# EasyEDA Pro project Jarvis.eprj, schematic Schematic2
Board Name: Memory; Create Date: 2026-04-10; Page Name: P1; Project Name: Jarvis; Schematic Name: Schematic2; Update Date: 2026-04-12; Company: EasyEDA.com; Page Size: A4; Version: V1.0
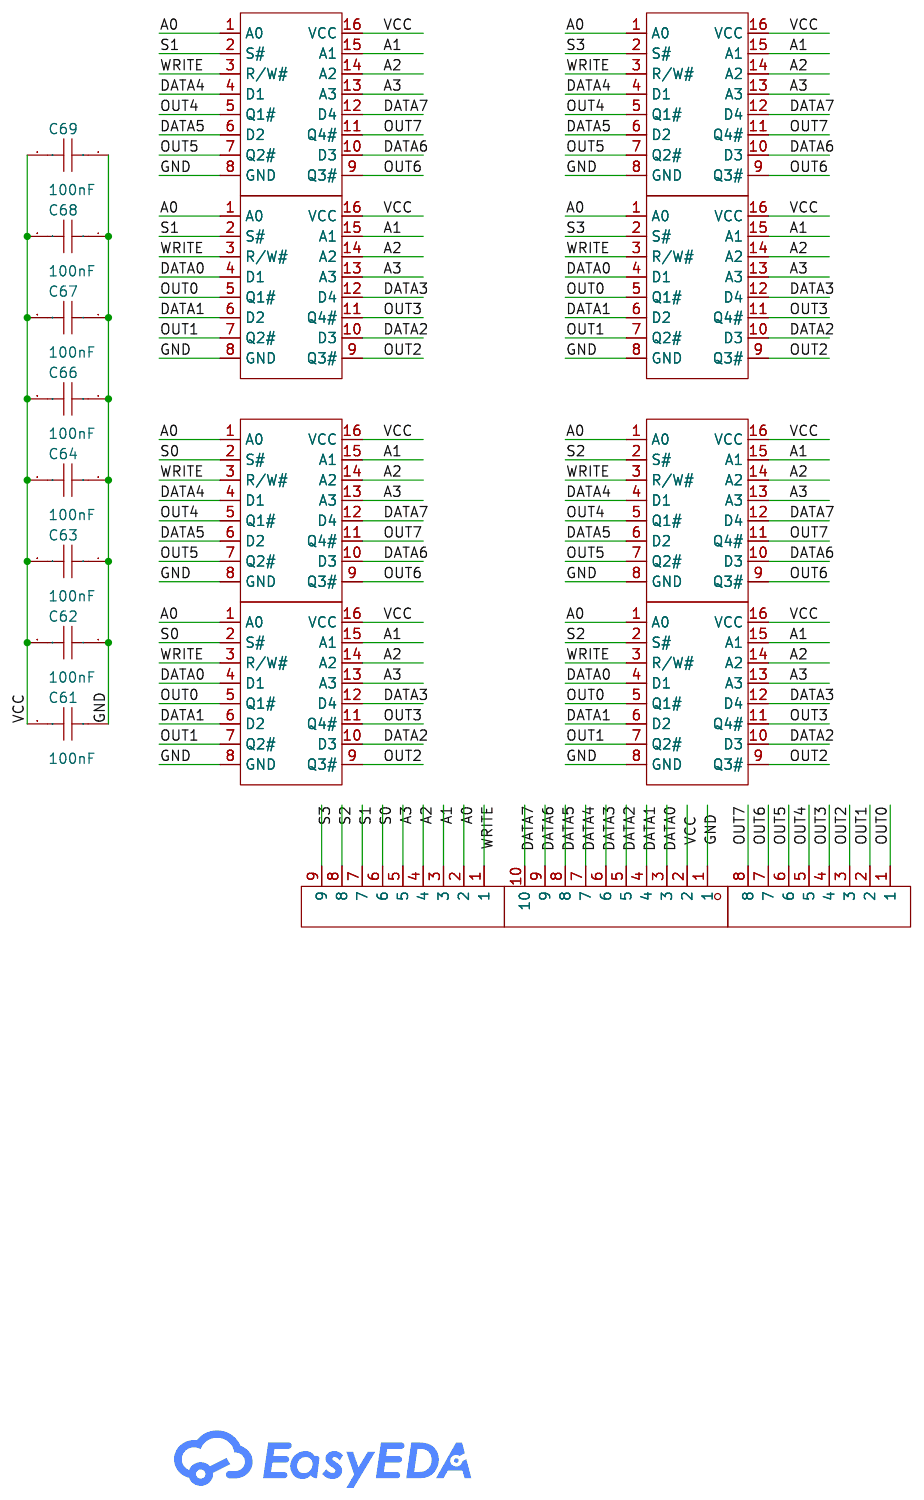
[diagram p0: schematic sheet]

## Parts
C61  100nF  [CAP-TH_L5.0-W2.5-P5.00-D1.0]
C62  100nF  [CAP-TH_L5.0-W2.5-P5.00-D1.0]
C63  100nF  [CAP-TH_L5.0-W2.5-P5.00-D1.0]
C64  100nF  [CAP-TH_L5.0-W2.5-P5.00-D1.0]
C66  100nF  [CAP-TH_L5.0-W2.5-P5.00-D1.0]
C67  100nF  [CAP-TH_L5.0-W2.5-P5.00-D1.0]
C68  100nF  [CAP-TH_L5.0-W2.5-P5.00-D1.0]
C69  100nF  [CAP-TH_L5.0-W2.5-P5.00-D1.0]
U356  TH2.54_8P_0.6  [HDR-TH_8P-P2.54-V-M-3]
U370  CD74HC173E  [PDIP-16_L19.2-W6.6-P2.54-LS7.6-BL]
U377  HDR2.54-LI-9P  [HDR-TH_9P-P2.54-V-M]
U378  CD74HC173E  [PDIP-16_L19.2-W6.6-P2.54-LS7.6-BL]
U379  CD74HC173E  [PDIP-16_L19.2-W6.6-P2.54-LS7.6-BL]
U380  CD74HC173E  [PDIP-16_L19.2-W6.6-P2.54-LS7.6-BL]
U381  CD74HC173E  [PDIP-16_L19.2-W6.6-P2.54-LS7.6-BL]
U382  CD74HC173E  [PDIP-16_L19.2-W6.6-P2.54-LS7.6-BL]
U383  CD74HC173E  [PDIP-16_L19.2-W6.6-P2.54-LS7.6-BL]
U384  CD74HC173E  [PDIP-16_L19.2-W6.6-P2.54-LS7.6-BL]
U385  cn10_2r54_10x1  [HDR-TH_10P-P2.54-V-F]

## Library data of the parts
C61-C64 C66-C69 = 178MU0006: LCSC Part Name: 100nF ±10% 50V; Supplier Part: C5632430; Manufacturer: KNSCHA(科尼盛); Supplier Footprint: 插件,P=2.54mm; JLCPCB Part Class: Extended Part; Datasheet: https://item.szlcsc.com/datasheet/178MU0006/6552585.html; Supplier: LCSC; Tolerance: ±10%; Voltage Rating: 50V; Temperature Coefficient: X7R; Pin Spacing: 2.54mm
U356 = TH2.54_8P_0.6: Supplier Part: C9900018349; Supplier Footprint: HDR-TH-8P; JLCPCB Part Class: Extended Part; Supplier: LCSC
U370 U378-U384 = CD74HC173E: LCSC Part Name: 三态高速CMOS逻辑四路D型触发器; Supplier Part: C1549968; Manufacturer: TI(德州仪器); Supplier Footprint: PDIP-16; JLCPCB Part Class: Extended Part; Datasheet: https://www.ti.com/cn/lit/gpn/cd74hct173; Supplier: LCSC; Type: D-Type; Trigger Type: Rising Edge; Voltage - Supply: 2V~6V; Clock Frequency: 60MHz; Function: Reset; Number of Elements: 1; Number of Bits per Element: 4; Output Type: Tri-State; Propagation Delay: 34ns@6V,50pF; Series: 74HC Series; Current - Output Low(IOL): 7.8mA; Current - Output High(IOH): 7.8mA; Quiescent Current: 8uA; Input Capacitance: 10pF; Operating Temperature: -55℃~+125℃; Setup Time: 12ns; Hold Time: 3ns
U377 = HDR2.54-LI-9P: Supplier Part: C9900020142; JLCPCB Part Class: Extended Part; Supplier: LCSC
U385 = cn10_2r54_10x1: Supplier Part: C9900001415; JLCPCB Part Class: Extended Part; Supplier: LCSC

## Nets
GND: C61.1 C62.1 C63.1 C64.1 C66.1 C67.1 C68.1 C69.1 U370.8(GND) U378.8(GND) U379.8(GND) U380.8(GND) U381.8(GND) U382.8(GND) U383.8(GND) U384.8(GND) U385.1
VCC: C61.2 C62.2 C63.2 C64.2 C66.2 C67.2 C68.2 C69.2 U370.16(VCC) U378.16(VCC) U379.16(VCC) U380.16(VCC) U381.16(VCC) U382.16(VCC) U383.16(VCC) U384.16(VCC) U385.2
A0: U370.1(A0) U377.2 U378.1(A0) U379.1(A0) U380.1(A0) U381.1(A0) U382.1(A0) U383.1(A0) U384.1(A0)
A1: U370.15(A1) U377.3 U378.15(A1) U379.15(A1) U380.15(A1) U381.15(A1) U382.15(A1) U383.15(A1) U384.15(A1)
A2: U370.14(A2) U377.4 U378.14(A2) U379.14(A2) U380.14(A2) U381.14(A2) U382.14(A2) U383.14(A2) U384.14(A2)
A3: U370.13(A3) U377.5 U378.13(A3) U379.13(A3) U380.13(A3) U381.13(A3) U382.13(A3) U383.13(A3) U384.13(A3)
DATA0: U370.4(D1) U379.4(D1) U381.4(D1) U383.4(D1) U385.3
DATA1: U370.6(D2) U379.6(D2) U381.6(D2) U383.6(D2) U385.4
DATA2: U370.10(D3) U379.10(D3) U381.10(D3) U383.10(D3) U385.5
DATA3: U370.12(D4) U379.12(D4) U381.12(D4) U383.12(D4) U385.6
DATA4: U378.4(D1) U380.4(D1) U382.4(D1) U384.4(D1) U385.7
DATA5: U378.6(D2) U380.6(D2) U382.6(D2) U384.6(D2) U385.8
DATA6: U378.10(D3) U380.10(D3) U382.10(D3) U384.10(D3) U385.9
DATA7: U378.12(D4) U380.12(D4) U382.12(D4) U384.12(D4) U385.10
OUT0: U356.1 U370.5(Q1#) U379.5(Q1#) U381.5(Q1#) U383.5(Q1#)
OUT1: U356.2 U370.7(Q2#) U379.7(Q2#) U381.7(Q2#) U383.7(Q2#)
OUT2: U356.3 U370.9(Q3#) U379.9(Q3#) U381.9(Q3#) U383.9(Q3#)
OUT3: U356.4 U370.11(Q4#) U379.11(Q4#) U381.11(Q4#) U383.11(Q4#)
OUT4: U356.5 U378.5(Q1#) U380.5(Q1#) U382.5(Q1#) U384.5(Q1#)
OUT5: U356.6 U378.7(Q2#) U380.7(Q2#) U382.7(Q2#) U384.7(Q2#)
OUT6: U356.7 U378.9(Q3#) U380.9(Q3#) U382.9(Q3#) U384.9(Q3#)
OUT7: U356.8 U378.11(Q4#) U380.11(Q4#) U382.11(Q4#) U384.11(Q4#)
S0: U370.2(S#) U377.6 U378.2(S#)
S1: U377.7 U379.2(S#) U380.2(S#)
S2: U377.8 U381.2(S#) U382.2(S#)
S3: U377.9 U383.2(S#) U384.2(S#)
WRITE: U370.3(R/W#) U377.1 U378.3(R/W#) U379.3(R/W#) U380.3(R/W#) U381.3(R/W#) U382.3(R/W#) U383.3(R/W#) U384.3(R/W#)
